# Altium schematic sheet GridSeed.SchDoc (part 2 of 2) (continued)
## Nets (continued)
AVDD_PLL: C250.1 FB1.2 R10.1 R12.1 R14.1 R16.1 R35.1 R37.1 R39.1 R41.1 R57.1 R59.1 R61.1 R63.1 R69.1 R71.1 R73.1 R75.1
BOOT1: C7.1 D1.3(CC) U17.8(BOOT)
BOOT2: C8.1 D2.3(CC) U18.8(BOOT)
BOOT3: C9.1 D3.3(CC) U19.8(BOOT)
CompFB+: C166.1 R29.1 U20.11(AN5/C1IN1+/VBUSON/VBUSST/RPI37/RB5)
CompFB-: C167.1 R30.1 U20.12(AN4/C1IN2-/USBOEN/RPI36/RB4)
CORE_CLKOUT_1: R1.2 U1.56(CORE_CLKOUT)
CORE_CLKOUT_2: R2.2 U2.56(CORE_CLKOUT)
CORE_CLKOUT_3: R3.2 U3.56(CORE_CLKOUT)
CORE_CLKOUT_4: R4.2 U4.56(CORE_CLKOUT)
CORE_CLKOUT_5: R17.1 U5.56(CORE_CLKOUT)
CORE_CLKOUT_6: R18.2 U6.56(CORE_CLKOUT)
CORE_CLKOUT_7: R19.2 U7.56(CORE_CLKOUT)
CORE_CLKOUT_8: R20.2 U8.56(CORE_CLKOUT)
CORE_CLKOUT_9: R44.2 U9.56(CORE_CLKOUT)
CORE_CLKOUT_10: R45.2 U10.56(CORE_CLKOUT)
CORE_CLKOUT_11: R46.2 U11.56(CORE_CLKOUT)
CORE_CLKOUT_12: R47.2 U12.56(CORE_CLKOUT)
CORE_CLKOUT_13: R64.2 U13.56(CORE_CLKOUT)
CORE_CLKOUT_14: R65.2 U14.56(CORE_CLKOUT)
CORE_CLKOUT_15: R66.2 U15.56(CORE_CLKOUT)
CORE_CLKOUT_16: R67.2 U16.56(CORE_CLKOUT)
D+: D11.1 J2.3 U20.37(D+/RG2)
D-: D11.3 J2.2 U20.36(D-/RG3)
DRVLogic: C4.1 C5.1 C6.1 U17.6(Vlogic) U18.6(Vlogic) U19.6(Vlogic) U20.55(C3IN1+/VCMPST3/RP71/RD7)
DVDD_PLL: C248.1 C249.1 C267.1 FB1.1 R9.1 R11.1 R13.1 R15.1 R34.1 R36.1 R38.1 R40.1 R50.1 R52.1 R56.1 R58.1 R60.1 R62.1 R68.1 R70.1 R72.1 R74.1 U26.1(OUTPUT) U27.1(OUTPUT)
FB: C152.1 R27.1 U20.17(PGEC1/AN6/RPI38/RB6)
GREEN: D5.2(A) U20.47(PGED2/SOSCI/C3IN3-/RPI61/RC13)
HO1: Q1.4(G) U17.1(HO)
HO2: Q2.4(G) U18.1(HO)
HO3: Q3.4(G) U19.1(HO)
LDO3.3V-5.0V: R43.1 R49.1 U26.5(N.C.) U26.8(INPUT) U27.5(N.C.) U27.8(INPUT)
LDO5.0V: C192.1 D8.1(C) D9.2(A) R32.1 R42.2 R49.2 U22.1(Vin) U22.3(STBY) U23.5(N.C.) U23.8(INPUT)
LM12V: D10.1(C) R48.1 U21.8(INPUT) U24.1(Vout) U25.1(Vout)
LO1: Q4.4(G) Q5.4(G) U17.3(LO)
LO2: Q6.4(G) Q7.4(G) U18.3(LO)
LO3: Q8.4(G) Q9.4(G) U19.3(LO)
LTC_EN: R6.1 U1.47(LTC_EN) U2.47(LTC_EN) U3.47(LTC_EN) U4.47(LTC_EN) U5.47(LTC_EN) U6.47(LTC_EN) U7.47(LTC_EN) U8.47(LTC_EN) U9.47(LTC_EN) U10.47(LTC_EN) U11.47(LTC_EN) U12.47(LTC_EN) U13.47(LTC_EN) U14.47(LTC_EN) U15.47(LTC_EN) U16.47(LTC_EN) U20.23(TMS/AN10/CVREF/PMA13/RPI42/RB10)
Main OSC In: C173.1 U20.39(OSC1/RPI60/RC12) Y1.1
Main OSC Out: C174.1 U20.40(OSC2/CLKO/RC15) Y1.2
MCLR: C168.1 J1.1 R31.1 U20.7(~{MCLR})
MCU5.0V: R33.2 U20.34(VBUS)
MEAS12: C139.1 R24.2 R25.2 U20.18(PGED1/AN7/RCV/RPI39/RB7)
ORANGE: D7.2(A) U20.45(PMCS1/RPI75/RD11)
PGC: J1.5 U20.15(PGEC3/AN1/VREF-/RPI33/RB1)
PGD: J1.4 U20.16(PGED3/AN0/VREF+/RPI32/RB0)
PWM2H: R22.1 U18.5(IN) U20.63(AN27/PWM2H/PMD3/RPI83/RE3)
PWM2L: R23.1 U17.5(IN) U20.62(AN26/PWM2L/PMD2/RP82/RE2)
PWM3L: R21.1 U19.5(IN) U20.64(AN28/PWM3L/PMD4/RP84/RE4)
RED: D4.2(A) U20.48(PGEC2/SOSCO/C3IN1-/T1CK/RPI62/RC14)
RX_BTC_0: U1.1(CFG_P) U2.1(CFG_P) U3.1(CFG_P) U4.1(CFG_P) U5.1(CFG_P) U6.1(CFG_P) U7.1(CFG_P) U8.1(CFG_P) U20.59(VCMPST2/RP97/RF1)
RX_BTC_1: U9.1(CFG_P) U10.1(CFG_P) U11.1(CFG_P) U12.1(CFG_P) U13.1(CFG_P) U14.1(CFG_P) U15.1(CFG_P) U16.1(CFG_P) U20.3(AN31/PWM4H/PMD7/RP87/RE7)
RX_LTC_0: U1.2(CFG_N) U2.2(CFG_N) U3.2(CFG_N) U4.2(CFG_N) U5.2(CFG_N) U6.2(CFG_N) U7.2(CFG_N) U8.2(CFG_N) U20.58(VCMPST1/RP96/RF0)
RX_LTC_1: U9.2(CFG_N) U10.2(CFG_N) U11.2(CFG_N) U12.2(CFG_N) U13.2(CFG_N) U14.2(CFG_N) U15.2(CFG_N) U16.2(CFG_N) U20.4(C1IN3-/SCK2/PMA5/RP118/RG6)
SWN1: C7.2 L1.1 Q1.1(S) Q1.2(S) Q1.3(S) Q4.5(D) Q4.6(D) Q4.7(D) Q4.8(D) Q5.5(D) Q5.6(D) Q5.7(D) Q5.8(D) U17.2(SW)
SWN2: C8.2 L2.1 Q2.1(S) Q2.2(S) Q2.3(S) Q6.5(D) Q6.6(D) Q6.7(D) Q6.8(D) Q7.5(D) Q7.6(D) Q7.7(D) Q7.8(D) U18.2(SW)
SWN3: C9.2 L3.1 Q3.1(S) Q3.2(S) Q3.3(S) Q8.5(D) Q8.6(D) Q8.7(D) Q8.8(D) Q9.5(D) Q9.6(D) Q9.7(D) Q9.8(D) U19.2(SW)
TP1: TP1.1 U20.6(C2IN3-/SDO2/PMA3/RP120/RG8)
TP2: TP2.1 U20.8(C2IN1-/PMA2/RPI121/RG9)
TP3: TP3.1 U20.21(AN8/PMA6/RPI40/RB8)
TP4: TP4.1 U20.22(AN9/PMA7//RPI41/RB9)
TP5: TP5.1 U20.24(TDO/AN11/PMA12/RPI43/RB11)
TP6: TP6.1 U20.27(TCK/AN12/PMA11/RPI44/RB12)
TP7: TP7.1 U20.28(TDI/AN13/PMA10/RPI45/RB13)
TP8: TP8.1 U20.29(AN14/PMA1/RPI46/RB14)
TP9: TP9.1 U20.30(AN15/PMA0/RPI47/RB15)
TP10: TP10.1 U20.31(SDA2/PMA9/RP100/RF4)
TP11: TP11.1 U20.32(SCL2/PMA8/RP101/RF5)
TP12: TP12.1 U20.33(USBID/RP99/RF3)
TP13: TP13.1 U20.42(RTCC/DMLN/RPI72/RD8)
TP14: TP14.1 U20.43(ASDA1/DPLN/RPI73/RD9)
TP15: TP15.1 U20.50(DPH/RP66/RD2)
TP16: TP16.1 U20.51(PMBE/RP67/RD3)
TP17: TP17.1 U20.54(C3IN2-/RP70/RD6)
TP18: TP18.1 U20.14(AN2/C2IN2-/VMIO/RPI34/RB2)
TP19: TP19.1 U20.13(AN3/C2IN1+/VPIO/RPI35/RB3)
TP1011: U1.25(RPT_BUSYN)
TP1012: U2.25(RPT_BUSYN)
TP1013: U3.25(RPT_BUSYN)
TP1014: U4.25(RPT_BUSYN)
TP1015: U5.25(RPT_BUSYN)
TP1016: U6.25(RPT_BUSYN)
TP1017: U7.25(RPT_BUSYN)
TP1018: U8.25(RPT_BUSYN)
TP1019: U9.25(RPT_BUSYN)
TP10110: U10.25(RPT_BUSYN)
TP10111: U11.25(RPT_BUSYN)
TP10112: U12.25(RPT_BUSYN)
TP10113: U13.25(RPT_BUSYN)
TP10114: U14.25(RPT_BUSYN)
TP10115: U15.25(RPT_BUSYN)
TP10116: U16.25(RPT_BUSYN)
TP_1001: U1.48(LTC_BUSYN)
TP_1002: U2.48(LTC_BUSYN)
TP_1003: U3.48(LTC_BUSYN)
TP_1004: U4.48(LTC_BUSYN)
TP_1005: U5.48(LTC_BUSYN)
TP_1006: U6.48(LTC_BUSYN)
TP_1007: U7.48(LTC_BUSYN)
TP_1008: U8.48(LTC_BUSYN)
TP_1009: U9.48(LTC_BUSYN)
TP_10010: U10.48(LTC_BUSYN)
TP_10011: U11.48(LTC_BUSYN)
TP_10012: U12.48(LTC_BUSYN)
TP_10013: U13.48(LTC_BUSYN)
TP_10014: U14.48(LTC_BUSYN)
TP_10015: U15.48(LTC_BUSYN)
TP_10016: U16.48(LTC_BUSYN)
TX_BTC_0: R7.1 U1.24(RPT_P) U2.24(RPT_P) U3.24(RPT_P) U4.24(RPT_P) U5.24(RPT_P) U6.24(RPT_P) U7.24(RPT_P) U8.24(RPT_P) U20.61(AN25/PWM1H/PMD1/RPI81/RE1)
TX_BTC_1: R54.1 U9.24(RPT_P) U10.24(RPT_P) U11.24(RPT_P) U12.24(RPT_P) U13.24(RPT_P) U14.24(RPT_P) U15.24(RPT_P) U16.24(RPT_P) U20.1(AN29/PWM3H/PMD5/RP85/RE5)
TX_LTC_0: R8.2 U1.23(RPT_N) U2.23(RPT_N) U3.23(RPT_N) U4.23(RPT_N) U5.23(RPT_N) U6.23(RPT_N) U7.23(RPT_N) U8.23(RPT_N) U20.60(AN24/PWM1L/PMD0/RP80/RE0)
TX_LTC_1: R55.2 U9.23(RPT_N) U10.23(RPT_N) U11.23(RPT_N) U12.23(RPT_N) U13.23(RPT_N) U14.23(RPT_N) U15.23(RPT_N) U16.23(RPT_N) U20.2(AN30/PWM4L/PMD6/RPI86/RE6)
USB5.0V: D11.4 D11.6 J2.1 R32.2 R33.1
VCAP: C138.1 U20.56(VCAP)
VDD_PLL_1: C86.1 C87.1 C88.1 C89.1 R9.2 U1.9(VDD_PLL)
VDD_PLL_2: C94.1 C95.1 C96.1 C97.1 R11.2 U2.9(VDD_PLL)
VDD_PLL_3: C102.1 C103.1 C104.1 C105.1 R13.2 U3.9(VDD_PLL)
VDD_PLL_4: C110.1 C111.1 C112.1 C113.1 R15.2 U4.9(VDD_PLL)
VDD_PLL_5: C195.1 C196.1 C197.1 C198.1 R34.2 U5.9(VDD_PLL)
VDD_PLL_6: C203.1 C204.1 C205.1 C206.1 R36.2 U6.9(VDD_PLL)
VDD_PLL_7: C211.1 C212.1 C213.1 C214.1 R38.2 U7.9(VDD_PLL)
VDD_PLL_8: C219.1 C220.1 C221.1 C222.1 R40.2 U8.9(VDD_PLL)
VDD_PLL_9: C293.1 C294.1 C295.1 C296.1 R56.2 U9.9(VDD_PLL)
VDD_PLL_10: C301.1 C302.1 C303.1 C304.1 R58.2 U10.9(VDD_PLL)
VDD_PLL_11: C309.1 C310.1 C311.1 C312.1 R60.2 U11.9(VDD_PLL)
VDD_PLL_12: C317.1 C318.1 C319.1 C320.1 R62.2 U12.9(VDD_PLL)
VDD_PLL_13: C385.1 C386.1 C387.1 C388.1 R68.2 U13.9(VDD_PLL)
VDD_PLL_14: C393.1 C394.1 C395.1 C396.1 R70.2 U14.9(VDD_PLL)
VDD_PLL_15: C401.1 C402.1 C403.1 C404.1 R72.2 U15.9(VDD_PLL)
VDD_PLL_16: C409.1 C410.1 C411.1 C412.1 R74.2 U16.9(VDD_PLL)
VDDA_PLL_1: C90.1 C91.1 C92.1 C93.1 R10.2 U1.8(VDDA_PLL)
VDDA_PLL_2: C98.1 C99.1 C100.1 C101.1 R12.2 U2.8(VDDA_PLL)
VDDA_PLL_3: C106.1 C107.1 C108.1 C109.1 R14.2 U3.8(VDDA_PLL)
VDDA_PLL_4: C114.1 C115.1 C116.1 C117.1 R16.2 U4.8(VDDA_PLL)
VDDA_PLL_5: C199.1 C200.1 C201.1 C202.1 R35.2 U5.8(VDDA_PLL)
VDDA_PLL_6: C207.1 C208.1 C209.1 C210.1 R37.2 U6.8(VDDA_PLL)
VDDA_PLL_7: C215.1 C216.1 C217.1 C218.1 R39.2 U7.8(VDDA_PLL)
VDDA_PLL_8: C223.1 C224.1 C225.1 C226.1 R41.2 U8.8(VDDA_PLL)
VDDA_PLL_9: C297.1 C298.1 C299.1 C300.1 R57.2 U9.8(VDDA_PLL)
VDDA_PLL_10: C305.1 C306.1 C307.1 C308.1 R59.2 U10.8(VDDA_PLL)
VDDA_PLL_11: C313.1 C314.1 C315.1 C316.1 R61.2 U11.8(VDDA_PLL)
VDDA_PLL_12: C321.1 C322.1 C323.1 C324.1 R63.2 U12.8(VDDA_PLL)
VDDA_PLL_13: C389.1 C390.1 C391.1 C392.1 R69.2 U13.8(VDDA_PLL)
VDDA_PLL_14: C397.1 C398.1 C399.1 C400.1 R71.2 U14.8(VDDA_PLL)
VDDA_PLL_15: C405.1 C406.1 C407.1 C408.1 R73.2 U15.8(VDDA_PLL)
VDDA_PLL_16: C413.1 C414.1 C415.1 C416.1 R75.2 U16.8(VDDA_PLL)
XCLK1: R26.2 U20.46(INT0/DMH/RP64/RD0) U20.49(VCPCON/RP65/RD1) U20.52(PMWR/RP68/RD4) U20.53(PMRD/RP69/RD5)
XCLKIN: R26.1 R28.1 U1.11(XCLKIN)
XCLKOUT_1: U1.12(XCLKOUT) U2.11(XCLKIN)
XCLKOUT_2: U2.12(XCLKOUT) U3.11(XCLKIN)
XCLKOUT_3: U3.12(XCLKOUT) U4.11(XCLKIN)
XCLKOUT_4: U4.12(XCLKOUT) U5.11(XCLKIN)
XCLKOUT_5: U5.12(XCLKOUT) U6.11(XCLKIN)
XCLKOUT_6: U6.12(XCLKOUT) U7.11(XCLKIN)
XCLKOUT_7: U7.12(XCLKOUT) U8.11(XCLKIN)
XCLKOUT_8: U8.12(XCLKOUT) U9.11(XCLKIN)
XCLKOUT_9: U9.12(XCLKOUT) U10.11(XCLKIN)
XCLKOUT_10: U10.12(XCLKOUT) U11.11(XCLKIN)
XCLKOUT_11: U11.12(XCLKOUT) U12.11(XCLKIN)
XCLKOUT_12: U12.12(XCLKOUT) U13.11(XCLKIN)
XCLKOUT_13: U13.12(XCLKOUT) U14.11(XCLKIN)
XCLKOUT_14: U14.12(XCLKOUT) U15.11(XCLKIN)
XCLKOUT_15: U15.12(XCLKOUT) U16.11(XCLKIN)
XCLKOUT_16: U16.12(XCLKOUT)
YELLOW: D6.2(A) U20.44(ASCL1/PMCS2/RPI74/RD10)
NetR50_2: R50.2 R51.1 U26.2(GND)
NetR52_2: R52.2 R53.1 U27.2(GND)

Not connected (* = marked no-connect by the designer): J2 4*; U23 2(GND) 3(GND) 4(N.C.); U26 3(GND) 4(N.C.); U27 3(GND) 4(N.C.)

## Notes on the sheet
- PD: GC3355 UART mode
- 0
- (near U1) 0
- (near U2) 1
- 1
- (near U3) 0
- (near U4) 1
- 0603SAJ010JT50
- close to pin 9 and 10
- (near C93) close to pin 7 and 8
- (near C101) close to pin 7 and 8
- (near C109) close to pin 7 and 8
- (near C117) close to pin 7 and 8
- CL21A225KPFNNNG
- CL21C101JBNC
- CL21C470JBNC
- CL21C220JBNC
- (near U5) 0
- (near U6) 1
- (near U7) 0
- (near C202) close to pin 7 and 8
- (near C210) close to pin 7 and 8
- (near C218) close to pin 7 and 8
- (near C226) close to pin 7 and 8
- BD00KA5WF-E2
- (near FB1) BLM21PG331SN1D-Farenll
- 10k=1V_output
- (near C248) 6.04k=0.9001V_output
- pin2=ADJ  !!!!!
- (near R51) 0603SAF0303T50
- (near U9) 0
- (near U10) 1
- (near U11) 0
- (near U12) 1
- (near R53) 0603SAF0303T50
- (near C300) close to pin 7 and 8
- (near C308) close to pin 7 and 8
- (near C316) close to pin 7 and 8
- (near C324) close to pin 7 and 8
- (near U15) 0
- (near U16) 1
- (near C392) close to pin 7 and 8
- close to pin 7 and 8
- (near C408) close to pin 7 and 8
- (near C416) close to pin 7 and 8
- (in symbol CON000000048) gnd

## Library data of the parts
C1-C3 C69 C138 C191 C192 C276 = CAP000043636: DB_PART_TYPE: Ceramic_SMD\Standard_X5R; DB_MANUFACTURER_PART: KEMET    C0805C106K4PAC; NOTE: <NOTE>; DB_T_RANGE: -55 to 85; DB_PACKAGE: 0805; DB_DESCRIPTION: C X5R 10uF 10% 16V 0805; DB_APPROVED_ON: 9.10.2010 г.; DB_STATUS: NEW; DB_PART_NUMBER: CAP000043636; DB_PCB_DEVICE: SMD_0805_CAPC2012X145N; DB_DATASHEET: http://john.epiqdesign.com/projects/CIS_Datasheets/F3102_CE_Kemet.pdf?rev=92&sc=0
C4-C6 = CAP000028589: DB_PART_TYPE: Ceramic_SMD\Standard_X7R; DB_MANUFACTURER_PART: KEMET    C0805C105J4RAC; NOTE: <NOTE>; DB_T_RANGE: -55 to 125; DB_PACKAGE: 0805; DB_DESCRIPTION: C X7R 1uF 5% 16V 0805; DB_APPROVED_ON: 9.10.2010 г.; DB_STATUS: NEW; DB_PART_NUMBER: CAP000028589; DB_PCB_DEVICE: SMD_0805_CAPC2012X145N; DB_DATASHEET: http://john.epiqdesign.com/projects/CIS_Datasheets/F3102_CE_Kemet.pdf?rev=92&sc=0
C7-C9 = CAP000027193: DB_PART_TYPE: Ceramic_SMD\Standard_X7R; DB_MANUFACTURER_PART: KEMET    C0805C104K5RAC; NOTE: <NOTE>; DB_T_RANGE: -55 to 125; DB_PACKAGE: 0805; DB_DESCRIPTION: C X7R 100nF 10% 50V 0805; DB_APPROVED_ON: 9.10.2010 г.; DB_STATUS: NEW; DB_PART_NUMBER: CAP000027193; DB_PCB_DEVICE: SMD_0805_CAPC2012X145N; DB_DATASHEET: http://john.epiqdesign.com/projects/CIS_Datasheets/F3102_CE_Kemet.pdf?rev=92&sc=0
C10 C11 C15 C16 C20 C21 = CAP000043701: DB_PART_TYPE: Ceramic_SMD\Standard_X5R; DB_MANUFACTURER_PART: KEMET    C1210C107M9PAC; NOTE: <NOTE>; DB_T_RANGE: -55 to 85; DB_PACKAGE: 1210; DB_DESCRIPTION: C X5R 100uF 20% 6.3V 1210; DB_APPROVED_ON: 9.10.2010 г.; DB_STATUS: NEW; DB_PART_NUMBER: CAP000043701; DB_PCB_DEVICE: SMD_1210_CAPC3225X270N; DB_DATASHEET: http://john.epiqdesign.com/projects/CIS_Datasheets/F3102_CE_Kemet.pdf?rev=92&sc=0
C12-C14 C17-C19 C22-C24 C193 C_1-C_72 = CAP000043682: DB_PART_TYPE: Ceramic_SMD\Standard_X5R; DB_MANUFACTURER_PART: KEMET    C1210C226K9PAC; NOTE: <NOTE>; DB_T_RANGE: -55 to 85; DB_PACKAGE: 1210; DB_DESCRIPTION: C X5R 22uF 10% 6.3V 1210; DB_APPROVED_ON: 9.10.2010 г.; DB_STATUS: NEW; DB_PART_NUMBER: CAP000043682; DB_PCB_DEVICE: SMD_1210_CAPC3225X270N; DB_DATASHEET: http://john.epiqdesign.com/projects/CIS_Datasheets/F3102_CE_Kemet.pdf?rev=92&sc=0
C25-C68 C70-C85 C118-C137 C140-C151 C153-C164 C175-C190 C227-C246 C251-C266 C268-C275 C277-C292 C325-C384 = CAP000028169: DB_PART_TYPE: Ceramic_SMD\Standard_X7R; DB_MANUFACTURER_PART: KEMET    C0603C474J4RAC; NOTE: <NOTE>; DB_TOLERANCE: 5%; DB_VOLTAGE: 16V; DB_T_RANGE: -55 to 125; DB_PACKAGE: 0603; DB_DESCRIPTION: C X7R 470nF 5% 16V 0603; DB_APPROVED_ON: 9.10.2010 г.; DB_STATUS: NEW; DB_PART_NUMBER: CAP000028169; DB_PCB_DEVICE: SMD_0603_CAPC1608X95N; DB_DATASHEET: http://john.epiqdesign.com/projects/CIS_Datasheets/F3102_CE_Kemet.pdf?rev=92&sc=0
C86 C90 C94 C98 C102 C106 C110 C114 C195 C199 C203 C207 C211 C215 C219 C223 C293 C297 C301 C305 C309 C313 C317 C321 C385 C389 C393 C397 C401 C405 C409 C413 = CAP000023413: DB_PART_TYPE: Ceramic_SMD\Open_Mode_X7R; DB_MANUFACTURER_PART: KEMET    C0805F225J8RAC; NOTE: <NOTE>; DB_T_RANGE: -55 to 125; DB_PACKAGE: 0805; DB_DESCRIPTION: C X7R 2.2uF 5% 10V 0805; DB_APPROVED_ON: 9.10.2010 г.; DB_STATUS: NEW; DB_PART_NUMBER: CAP000023413; DB_PCB_DEVICE: SMD_0805_CAPC2012X145N; DB_DATASHEET: http://john.epiqdesign.com/projects/CIS_Datasheets/F3102_CE_Kemet.pdf?rev=92&sc=0
C87 C91 C95 C99 C103 C107 C111 C115 C196 C200 C204 C208 C212 C216 C220 C224 C294 C298 C302 C306 C310 C314 C318 C322 C386 C390 C394 C398 C402 C406 C410 C414 = CAP000034173: DB_PART_TYPE: Ceramic_SMD\Standard_C0G; DB_MANUFACTURER_PART: KEMET    C0805C101J5GAC; NOTE: <NOTE>; DB_T_RANGE: -55 to 125; DB_PACKAGE: 0805; DB_DESCRIPTION: C C0G 100pF 5% 50V 0805; DB_APPROVED_ON: 9.10.2010 г.; DB_STATUS: NEW; DB_PART_NUMBER: CAP000034173; DB_PCB_DEVICE: SMD_0805_CAPC2012X145N; DB_DATASHEET: http://john.epiqdesign.com/projects/CIS_Datasheets/F3102_CE_Kemet.pdf?rev=92&sc=0
C88 C92 C96 C100 C104 C108 C112 C116 C197 C201 C205 C209 C213 C217 C221 C225 C295 C299 C303 C307 C311 C315 C319 C323 C387 C391 C395 C399 C403 C407 C411 C415 = CAP000033220: DB_PART_TYPE: Ceramic_SMD\Standard_C0G; DB_MANUFACTURER_PART: KEMET    C0805C470J5GAC; NOTE: <NOTE>; DB_T_RANGE: -55 to 125; DB_PACKAGE: 0805; DB_DESCRIPTION: C C0G 47pF 5% 50V 0805; DB_APPROVED_ON: 9.10.2010 г.; DB_STATUS: NEW; DB_PART_NUMBER: CAP000033220; DB_PCB_DEVICE: SMD_0805_CAPC2012X145N; DB_DATASHEET: http://john.epiqdesign.com/projects/CIS_Datasheets/F3102_CE_Kemet.pdf?rev=92&sc=0
  C197: DB_VALUE: 47pF
C89 C93 C97 C101 C105 C109 C113 C117 C198 C202 C206 C210 C214 C218 C222 C226 C296 C300 C304 C308 C312 C316 C320 C324 C388 C392 C396 C400 C404 C408 C412 C416 = CAP000032204: DB_PART_TYPE: Ceramic_SMD\Standard_C0G; DB_MANUFACTURER_PART: KEMET    C0805C220J5GAC; NOTE: <NOTE>; DB_T_RANGE: -55 to 125; DB_PACKAGE: 0805; DB_DESCRIPTION: C C0G 22pF 5% 50V 0805; DB_APPROVED_ON: 9.10.2010 г.; DB_STATUS: NEW; DB_PART_NUMBER: CAP000032204; DB_PCB_DEVICE: SMD_0805_CAPC2012X145N; DB_DATASHEET: http://john.epiqdesign.com/projects/CIS_Datasheets/F3102_CE_Kemet.pdf?rev=92&sc=0
C139 = CAP000024113: DB_PART_TYPE: Ceramic_SMD\Standard_X7R; DB_MANUFACTURER_PART: KEMET    C0603C102J3RAC; NOTE: <NOTE>; DB_TOLERANCE: 5%; DB_VOLTAGE: 25V; DB_T_RANGE: -55 to 125; DB_PACKAGE: 0603; DB_DESCRIPTION: C X7R 1nF 5% 25V 0603; DB_APPROVED_ON: 9.10.2010 г.; DB_STATUS: NEW; DB_PART_NUMBER: CAP000024113; DB_VALUE: 1nF; DB_PCB_DEVICE: SMD_0603_CAPC1608X95N; DB_DATASHEET: http://john.epiqdesign.com/projects/CIS_Datasheets/F3102_CE_Kemet.pdf?rev=92&sc=0
C152 C166 C167 = CAP000024113: DB_PART_TYPE: Ceramic_SMD\Standard_X7R; DB_MANUFACTURER_PART: KEMET    C0603C102J3RAC; NOTE: <NOTE>; DB_T_RANGE: -55 to 125; DB_PACKAGE: 0603; DB_DESCRIPTION: C X7R 1nF 5% 25V 0603; DB_APPROVED_ON: 9.10.2010 г.; DB_STATUS: NEW; DB_PART_NUMBER: CAP000024113; DB_VALUE: 1nF; DB_PCB_DEVICE: SMD_0603_CAPC1608X95N; DB_DATASHEET: http://john.epiqdesign.com/projects/CIS_Datasheets/F3102_CE_Kemet.pdf?rev=92&sc=0
C165 C168-C172 C249 C250 = CAP000027136: DB_PART_TYPE: Ceramic_SMD\Standard_X7R; DB_MANUFACTURER_PART: KEMET    C0603C104J5RAC; NOTE: <NOTE>; DB_T_RANGE: -55 to 125; DB_PACKAGE: 0603; DB_DESCRIPTION: C X7R 100nF 5% 50V 0603; DB_APPROVED_ON: 9.10.2010 г.; DB_STATUS: NEW; DB_PART_NUMBER: CAP000027136; DB_VALUE: 100nF; DB_PCB_DEVICE: SMD_0603_CAPC1608X95N; DB_DATASHEET: http://john.epiqdesign.com/projects/CIS_Datasheets/F3102_CE_Kemet.pdf?rev=92&sc=0
C173 C174 = CAP000031922: DB_PART_TYPE: Ceramic_SMD\Standard_C0G; DB_MANUFACTURER_PART: KEMET    C0603C180J5GAC; NOTE: <NOTE>; DB_T_RANGE: -55 to 125; DB_PACKAGE: 0603; DB_DESCRIPTION: C C0G 18pF 5% 50V 0603; DB_APPROVED_ON: 9.10.2010 г.; DB_STATUS: NEW; DB_PART_NUMBER: CAP000031922; DB_VALUE: 18pF; DB_PCB_DEVICE: SMD_0603_CAPC1608X95N; DB_DATASHEET: http://john.epiqdesign.com/projects/CIS_Datasheets/F3102_CE_Kemet.pdf?rev=92&sc=0
C194 C248 C267 = CAP000043686: DB_PART_TYPE: Ceramic_SMD\Standard_X5R; DB_MANUFACTURER_PART: KEMET    C0805C226M9PAC; NOTE: <NOTE>; DB_T_RANGE: -55 to 85; DB_PACKAGE: 0805; DB_DESCRIPTION: C X5R 22uF 20% 6.3V 0805; DB_APPROVED_ON: 9.10.2010 г.; DB_STATUS: NEW; DB_PART_NUMBER: CAP000043686; DB_PCB_DEVICE: SMD_0805_CAPC2012X145N; DB_DATASHEET: http://john.epiqdesign.com/projects/CIS_Datasheets/F3102_CE_Kemet.pdf?rev=92&sc=0
D1-D3 = DDE000000490: DB_PART_TYPE: Schottky; DB_MANUFACTURER_PART: Diodes        BAT54C; NOTE: <NOTE>; DB_T_RANGE: -65 to +150; DB_VOLTAGE: 30V; DB_CURRENT: 200mA; DB_PACKAGE: SOT23; DB_DESCRIPTION: D BAT54C SOT23; DB_APPROVED_ON: 9.10.2010 г.; DB_STATUS: NEW; DB_PART_NUMBER: DDE000000490; DB_VALUE: BAT54C; DB_PCB_DEVICE: SMD_SOT23_SOT95P240X120-3N
D4-D7 = LED_2: NOTE: <NOTE>
D8-D10 = DDE000000580: DB_PART_TYPE: Schottky; DB_MANUFACTURER_PART: Diodes        B140; NOTE: <NOTE>; DB_T_RANGE: -65 to +150; DB_VOLTAGE: 40V; DB_CURRENT: 1A; DB_PACKAGE: SMA; DB_DESCRIPTION: D B140 SMA; DB_APPROVED_ON: 9.10.2010 г.; DB_STATUS: NEW; DB_PART_NUMBER: DDE000000580; DB_PCB_DEVICE: SMD_DO214AC_SMA
D11 = DDE000002846: DB_PART_TYPE: ESD protection; DB_MANUFACTURER_PART: ON SEMICONDUCTOR        SMS05T1G; DB_T_RANGE: -55 to 150; DB_VOLTAGE: 5V; DB_PACKAGE: SC-74; DB_DESCRIPTION: D SMS05T1G SC-74; DB_APPROVED_BY: VSN; DB_APPROVED_ON: 24.3.2014 г. 10:22:08; DB_STATUS: NEW; DB_PART_NUMBER: DDE000002846; DB_VALUE: SMS05T1G; DB_PCB_DEVICE: SMD_SOT457_SOT95P275X110-6N; DB_DATASHEET: http://john.epiqdesign.com/projects/CIS_Datasheets/IC_SMS05T1-D.pdf?rev=1323&sc=0
D12 = DDE000001725: DB_PART_TYPE: TVS; DB_MANUFACTURER_PART: Diodes        SMCJ12A; NOTE: <NOTE>; DB_T_RANGE: -55 to 150; DB_VOLTAGE: 12V; DB_CURRENT: 75A(Max); DB_PACKAGE: SMC; DB_DESCRIPTION: D SMCJ12A SMC; DB_APPROVED_ON: 9.10.2010 г.; DB_STATUS: NEW; DB_PART_NUMBER: DDE000001725; DB_PCB_DEVICE: SMD_DO214AC_SMC
FB1 = IND000000029: DB_PART_TYPE: Inductor; DB_MANUFACTURER_PART: MURATA       BLM21PG221SN1D; NOTE: <NOTE>; DB_TOLERANCE: 25%; DB_T_RANGE: -55 to 125; DB_PACKAGE: 0805; DB_DESCRIPTION: INDUC 220 Ohms 25% 0805; DB_APPROVED_BY: VSN; DB_APPROVED_ON: 30.6.2011 г. 07:59:29; DB_STATUS: NEW; DB_PART_NUMBER: IND000000029; DB_PCB_DEVICE: SMD_0805_INDC2012X105N; DB_DATASHEET: http://john.epiqdesign.com/projects/CIS_Datasheets/BLM21P_MURATA.pdf?rev=325&sc=0
J1 = CON5: Connector
J2 = CON000000048: DB_PART_TYPE: Connector; DB_MANUFACTURER_PART: CVILUX       CU04-SCM15B0-R0-LF; NOTE: <NOTE>; DB_PINS_NUMBER: 5; DB_PITCH: 0.8; DB_PACKAGE: SMD; DB_DESCRIPTION: CONN  PCB  5P  F  A  USB5 MINI SMD; DB_APPROVED_BY: VSN; DB_APPROVED_ON: 2.5.2011 г. 10:29:38; DB_STATUS: NEW; DB_PART_NUMBER: CON000000048; DB_PCB_DEVICE: SMD_CON-CVILUX-CU04-SCM15B0; DB_DATASHEET: http://john.epiqdesign.com/projects/CIS_Datasheets/USB%20MINI_CVILUX.pdf?rev=249&sc=0
J4 = CON_PCI-E: 4.20mm Male Dual Row Angled Header WR-MPC4
L1-L3 = L
Q1-Q9 = MOS_N_D1_S1S2S3G4D5D6D7D8: NOTE: <NOTE>
R1-R8 R17-R24 R31 R33 R44-R47 R50 R52 R54 R55 R64-R67 = RES000008663: DB_PART_TYPE: SMD; DB_MANUFACTURER_PART: YAGEO    RC0603FR-0710KL; NOTE: <NOTE>; DB_T_RANGE: -55 to 155; DB_POWER: 1/10W; DB_PACKAGE: 0603; DB_DESCRIPTION: R SMD 10k 1% 1/10W 0603; DB_APPROVED_BY: VSN; DB_APPROVED_ON: 8.8.2011 г. 08:31:51; DB_STATUS: NEW; R_BDS: R; DB_PART_NUMBER: RES000008663; DB_PCB_DEVICE: SMD_0603_RESC1608X55N; DB_DATASHEET: http://john.epiqdesign.com/projects/CIS_Datasheets/PYu-RC0603_51_RoHS_L_4_YAGEO.pdf?rev=138&sc=0
R9-R16 R34-R41 R56-R63 R68-R75 = RES000001175: DB_PART_TYPE: SMD; DB_MANUFACTURER_PART: YAGEO    RC0603FR-071R02; NOTE: <NOTE>; DB_T_RANGE: -55 to 155; DB_POWER: 1/10W; DB_PACKAGE: 0603; DB_DESCRIPTION: R SMD 1R02 1% 1/10W 0603; DB_PRICE: 0.00063; DB_MOQ: 5000; DB_APPROVED_ON: 9.10.2010 г.; DB_STATUS: NEW; R_BDS: R; DB_PART_NUMBER: RES000001175; DB_PCB_DEVICE: SMD_0603_RESC1608X55N; DB_PRICE_DATE: 2010-12-23; DB_DATASHEET: http://john.epiqdesign.com/projects/CIS_Datasheets/PYu-RC0603_51_RoHS_L_4_YAGEO.pdf?rev=138&sc=0
R25 = RES000006261: DB_PART_TYPE: SMD; DB_MANUFACTURER_PART: YAGEO    RC0603FR-072K4; NOTE: <NOTE>; DB_T_RANGE: -55 to 155; DB_POWER: 1/10W; DB_PACKAGE: 0603; DB_DESCRIPTION: R SMD 2K4 1% 1/10W 0603; DB_PRICE: 0.00063; DB_MOQ: 5000; DB_APPROVED_ON: 9.10.2010 г.; DB_STATUS: NEW; R_BDS: R; DB_PART_NUMBER: RES000006261; DB_PCB_DEVICE: SMD_0603_RESC1608X55N; DB_PRICE_DATE: 2010-12-23; DB_DATASHEET: http://john.epiqdesign.com/projects/CIS_Datasheets/PYu-RC0603_51_RoHS_L_4_YAGEO.pdf?rev=138&sc=0
R26 R28 = RES000006220: DB_PART_TYPE: SMD; DB_MANUFACTURER_PART: YAGEO    RC0603FR-0747R; NOTE: <NOTE>; DB_T_RANGE: -55 to 155; DB_POWER: 1/10W; DB_PACKAGE: 0603; DB_DESCRIPTION: R SMD 47R 1% 1/10W 0603; DB_PRICE: 0.00063; DB_MOQ: 5000; DB_APPROVED_ON: 9.10.2010 г.; DB_STATUS: NEW; R_BDS: R; DB_PART_NUMBER: RES000006220; DB_PCB_DEVICE: SMD_0603_RESC1608X55N; DB_PRICE_DATE: 2010-12-23; DB_DATASHEET: http://john.epiqdesign.com/projects/CIS_Datasheets/PYu-RC0603_51_RoHS_L_4_YAGEO.pdf?rev=138&sc=0
R27 R29 R30 = RES000008663: DB_PART_TYPE: SMD; DB_MANUFACTURER_PART: YAGEO    RC0603FR-0710KL; NOTE: <NOTE>; DB_TOLERANCE: 1%; DB_T_RANGE: -55 to 155; DB_POWER: 1/10W; DB_PACKAGE: 0603; DB_DESCRIPTION: R SMD 10k 1% 1/10W 0603; DB_APPROVED_BY: VSN; DB_APPROVED_ON: 8.8.2011 г. 08:31:51; DB_STATUS: NEW; R_BDS: R; DB_PART_NUMBER: RES000008663; DB_PCB_DEVICE: SMD_0603_RESC1608X55N; DB_DATASHEET: http://john.epiqdesign.com/projects/CIS_Datasheets/PYu-RC0603_51_RoHS_L_4_YAGEO.pdf?rev=138&sc=0
R32 = RES000008926: DB_PART_TYPE: SMD; DB_MANUFACTURER_PART: YAGEO    AC0603FR-070RL; NOTE: <NOTE>; DB_T_RANGE: -55 to 155; DB_POWER: 1/10W; DB_PACKAGE: 0603; DB_DESCRIPTION: R SMD 0R 1% 1/10W 0603; DB_CERTIFIED: AUT; DB_APPROVED_BY: VSN; DB_APPROVED_ON: 21.5.2013 г. 09:19:53; DB_STATUS: NEW; R_BDS: R; DB_PART_NUMBER: RES000008926; DB_PCB_DEVICE: SMD_0603_RESC1608X55N; DB_DATASHEET: http://john.epiqdesign.com/projects/CIS_Datasheets/RES_AC_YAGEO.pdf?rev=263&sc=0
R42 = RES000007051: DB_PART_TYPE: SMD; DB_MANUFACTURER_PART: YAGEO    RC1206JR-072R; NOTE: <NOTE>; DB_T_RANGE: -55 to 155; DB_POWER: 1/4W; DB_PACKAGE: 1206; DB_DESCRIPTION: R SMD 2R 5% 1/4W 1206; DB_APPROVED_ON: 9.10.2010 г.; DB_STATUS: NEW; R_BDS: R; DB_PART_NUMBER: RES000007051; DB_PCB_DEVICE: SMD_1206_RESC3216X65N; DB_DATASHEET: http://john.epiqdesign.com/projects/CIS_Datasheets/PYu-RC1206_51_RoHS_L_4_YAGEO.pdf?rev=138&sc=0
R43 R49 = RES000008756: DB_PART_TYPE: SMD; DB_MANUFACTURER_PART: YAGEO    AC1206FR-070RL; NOTE: <NOTE>; DB_T_RANGE: -55 to 155; DB_POWER: 1/4W; DB_PACKAGE: 1206; DB_DESCRIPTION: R SMD 0R 1% 1/4W 1206; DB_CERTIFIED: AUT; DB_APPROVED_BY: VSN; DB_APPROVED_ON: 27.4.2012 г. 12:25:00; DB_STATUS: NEW; R_BDS: R; DB_PART_NUMBER: RES000008756; DB_PCB_DEVICE: SMD_1206_RESC3216X65N; DB_DATASHEET: http://john.epiqdesign.com/projects/CIS_Datasheets/RES_AC_YAGEO.pdf?rev=263&sc=0
R48 = RES000006922: DB_PART_TYPE: SMD; DB_MANUFACTURER_PART: YAGEO    RC1206FR-07100R; NOTE: <NOTE>; DB_T_RANGE: -55 to 155; DB_POWER: 1/4W; DB_PACKAGE: 1206; DB_DESCRIPTION: R SMD 100R 1% 1/4W 1206; DB_APPROVED_ON: 9.10.2010 г.; DB_STATUS: NEW; R_BDS: R; DB_PART_NUMBER: RES000006922; DB_PCB_DEVICE: SMD_1206_RESC3216X65N; DB_DATASHEET: http://john.epiqdesign.com/projects/CIS_Datasheets/PYu-RC1206_51_RoHS_L_4_YAGEO.pdf?rev=138&sc=0
R51 R53 = RES000006287: DB_PART_TYPE: SMD; DB_MANUFACTURER_PART: YAGEO    RC0603FR-0730K; NOTE: <NOTE>; DB_T_RANGE: -55 to 155; DB_POWER: 1/10W; DB_PACKAGE: 0603; DB_DESCRIPTION: R SMD 30K 1% 1/10W 0603; DB_PRICE: 0.00063; DB_MOQ: 5000; DB_APPROVED_ON: 9.10.2010 г.; DB_STATUS: NEW; R_BDS: R; DB_PART_NUMBER: RES000006287; DB_PCB_DEVICE: SMD_0603_RESC1608X55N; DB_PRICE_DATE: 2010-12-23; DB_DATASHEET: http://john.epiqdesign.com/projects/CIS_Datasheets/PYu-RC0603_51_RoHS_L_4_YAGEO.pdf?rev=138&sc=0
TP1-TP19 = TPO000000001: DB_PART_TYPE: Test Point; DB_VALUE: 100_254; DB_DESCRIPTION: Test Point 100_254; DB_APPROVED_ON: 10.9.2010 г.; DB_STATUS: NEW; DB_PART_NUMBER: TPO000000001; DB_DIAMETER: 100_254; DB_PCB_DEVICE: SMD_TP_100-254
U1-U16 = GC3355Q64: GridSeed
U17-U19 = DRVFET_LTC4442: Mosfet 12V Dual Bootstrapped PWM Sync Buck Optimised
U20 = MCU000000070: DB_PART_TYPE: DSP; DB_MANUFACTURER_PART: MICROCHIP        DSPIC33EP256MU806-E/PT; OriginalSymbolOrigin: (30000,20000); < Value >: Type; DeviceNumbering: Alpha; DeviceDesignator: A; DevicesInPackage: 1; IsHeterogeneous: False; DB_T_RANGE: -40 to 125; DB_PACKAGE: TQFP-64; DB_DESCRIPTION: IC dsPIC33EP256MU806 TQFP-64; DB_CERTIFIED: AUT; DB_APPROVED_BY: VSN; DB_APPROVED_ON: 17.7.2012 г. 14:21:28; DB_STATUS: NEW; Package: <Package>; DevicesInView: 1; PackageName: PIC24FJ16GA004_X_PT; DB_PART_NUMBER: MCU000000070; DB_PCB_DEVICE: SMD_QFP50P1200X1200X120-64N; DB_DATASHEET: http://john.epiqdesign.com/projects/CIS_Datasheets/dsPIC33EPxxx-Microchip.pdf?rev=798&sc=0
U21 U23 = IC_LM2931AD-5.0R2G_SO-8
U22 = VOLTREG LDO
U24 U25 = IC_Vout1GND2Vin3: NOTE: <NOTE>
U26 U27 = IC_LM2931AD-5.0R2G_SO-8: to be replaced by BD00KA5WF-E2
Y1 = OSC000000012: DB_PART_TYPE: Oscillator; DB_MANUFACTURER_PART: IQD       4.00MHz HC49/4HSMX; NOTE: <NOTE>; DB_ACCURACY: 100ppm; DB_T_RANGE: -10 to 60; DB_FREQUENCY: 4MHz; DB_PACKAGE: SMD; DB_DESCRIPTION: IC  4.00MHz HC49/4HSMX  SMD; DB_APPROVED_BY: VSN; DB_APPROVED_ON: 26.4.2012 г. 15:32:29; DB_STATUS: NEW; DB_PART_NUMBER: OSC000000012; DB_VALUE: 4.00MHz HC49/4HSMX; DB_PCB_DEVICE: SMD_HC49_XTAL1140X480X420N; DB_DATASHEET: http://john.epiqdesign.com/projects/CIS_Datasheets/hc49-4hsmx_IQD_oscillators.pdf?rev=713&sc=0